# EasyEDA Pro project URADORRY-SUN1.2.eprj, board Main(1.2) (continued)
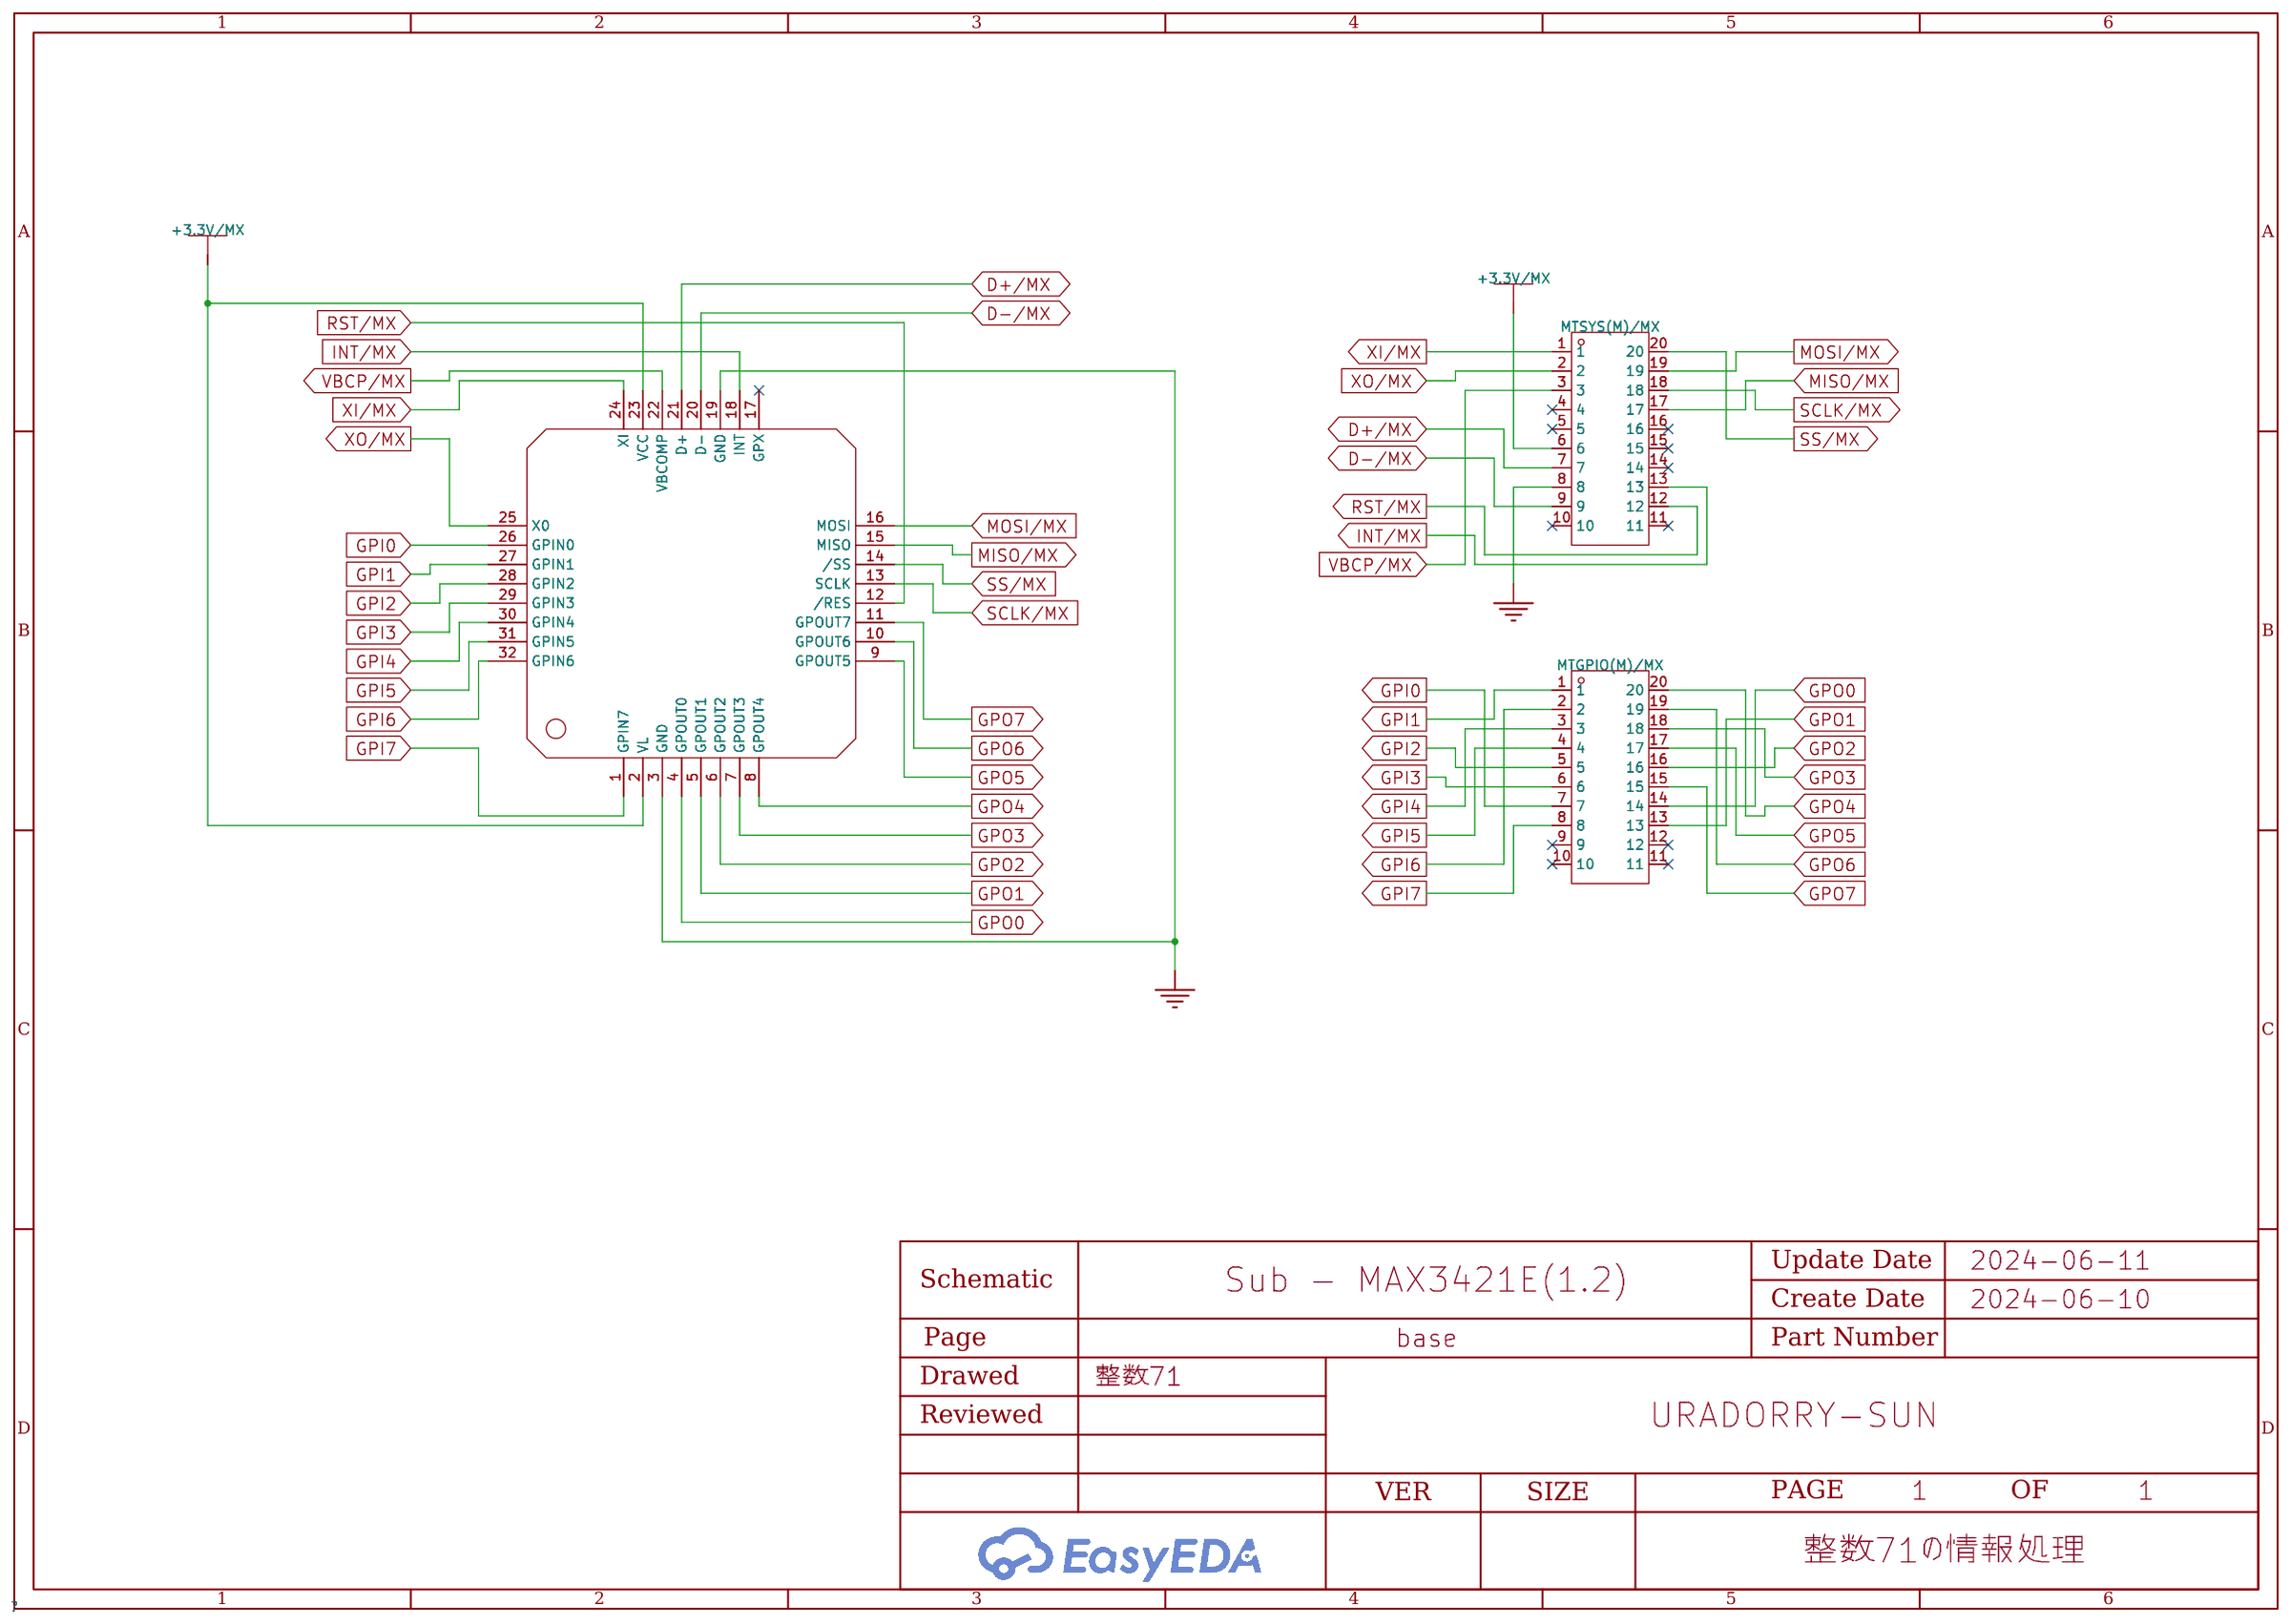
[diagram p0: schematic sheet]
## Routing (per net, layer and track width the routed paths; a pad name or vN(x,y) marks a point on that pad's centre or on a via; arc(x,y) is an arc through that point) (continued)
+3.3V/MX: length 43.3
  Top Layer w0.254: JP+3.3V.3 66.99,11.75 v1(65.09,11.75) ; RINT/MX.1 33.46,19.06 34.28,19.06 v1(34.29,19.05) ; v1(39.69,20) 39.69,21.27 40,21.59 40,21.61 40.85,21.61
  Bottom Layer w0.254: v1(65.09,11.75) 62.87,11.75 61.59,13.02 60.01,13.02 59.37,13.65 57.78,13.65 57.15,14.29 56.2,14.29 54.93,15.56 52.39,15.56 52.07,15.24 51.12,15.24 50.16,16.19 49.21,16.19 47.31,18.1 44.77,18.1 44.45,18.42 42.86,18.42 42.23,19.05 40.64,19.05 v1(39.69,20) 35.24,20 v1(34.29,19.05)
+5V/U: length 122.9
  Top Layer w0.254: v1(73.34,14.61) 73.34,13.65 73.52,13.48 Type-C.A4B9 ; Type-A.1 11.43,25.89 11.43,29.21 11.75,29.53 11.75,30.8 13.02,32.07 13.02,33.66 v1(13.97,34.61) ; v1(59.69,36.2) 58.74,37.15 v1(56.83,37.15) ; Micro-B.1 75.53,25.37 v1(75.25,25.08) ; v1(72.39,38.42) v1(70.49,38.42) ; v1(73.34,18.73) 73.8,18.28 Type-C.B4A9 ; v1(64.45,38.74) v1(62.23,38.74)
  Bottom Layer w0.254: JP+5V.3 78.11,8.26 73.98,8.26 73.03,9.21 73.03,9.84 73.34,10.16 v1(73.34,14.61) 73.34,16.83 73.99,17.47 73.99,18.1 73.35,18.73 v1(73.34,18.73) 73.34,22.23 74.61,23.5 74.61,24.45 v1(75.25,25.08) 75.25,25.72 78.11,28.58 78.11,29.53 77.79,29.85 77.79,30.48 79.38,32.07 79.38,32.7 78.42,33.66 77.79,33.66 76.84,34.61 76.84,37.78 75.88,38.74 75.25,38.74 74.93,38.42 v1(72.39,38.42) ; v1(13.97,34.61) 30.8,34.61 33.34,37.15 v1(56.83,37.15) ; v1(59.69,36.2) v1(62.23,38.74) ; v1(70.49,38.42) 70.17,38.74 v1(64.45,38.74)
AREF/AT: length 8.2
  Top Layer w0.254: v1(55.88,16.83) 55.25,16.19 CAREF/AT.2 ; v1(58.74,19.05) 59.37,19.69 59.37,20 60.08,20.71 MTSYS(F)/AT.15
  Bottom Layer w0.254: v1(58.74,19.05) 57.78,18.1 57.78,17.78 56.83,16.83 v1(55.88,16.83)
CTS-AT/AD: length 11.8
  Top Layer w0.254: UARTtoRS232C.9 22.61,27.69 22.86,27.94 23.81,27.94 24.45,27.31 24.45,20.64 JPCTS-AT.2
CTS-RS/AD: length 12.3
  Top Layer w0.254: 22.61,21.3 22.61,22.79 21.59,23.81 v1(17.78,23.81)
  Bottom Layer w0.254: JPCTS-RS.1 17.15,20.32 17.15,23.18 v1(17.78,23.81)
CTS/AT: length 54.3
  Top Layer w0.254: LEDTX/AT.1 66.21,13.65 v1(60.96,13.65) ; JPCTS-AT.1 27.31,20.32 v1(27.31,24.45) ; v1(52.71,17.78) 53.02,18.1 53.97,18.1 54.58,18.71 55.72,18.71 55.88,18.55 55.88,17.78 56.52,17.15 56.52,16.19 v1(57.15,15.56)
  Bottom Layer w0.254: v1(52.71,17.78) 52.07,17.15 51.12,17.15 50.16,18.1 49.53,18.1 46.36,21.27 45.72,21.27 44.77,22.23 43.18,22.23 39.37,26.04 29.53,26.04 28.89,25.4 28.26,25.4 v1(27.31,24.45) ; v1(57.15,15.56) 58.42,14.29 59.37,14.29 60.01,13.65 v1(60.96,13.65)
CTS/RS: length 18.9
  Bottom Layer w0.254: JPCTS-RS.2 12.07,20.32 12.07,29.53 11.75,29.85 11.75,30.8 12.7,31.75 15.88,31.75 16.19,32.07 16.19,32.07 17.26,33.14 D-SUB(9F).8
D+/AT: length 25.6
  Top Layer w0.254: v1(69.22,18.1) 66.99,20.32 66.99,21.27 65.72,22.54 65.72,22.86 65.38,23.21 MTAPP(F)/AT.1 ; v1(73.03,6.67) 73.98,5.72 75.56,5.72 JPD+.2
  Bottom Layer w0.254: v1(69.22,18.1) 69.22,11.11 70.49,9.84 70.49,9.21 71.44,8.26 72.07,8.26 73.03,7.3 v1(73.03,6.67)
D+/MX: length 18.1
  Top Layer w0.254: RD+/UH.1 27.62,15.88 31.75,20 31.75,21.91 32.39,22.54 33.02,22.54 33.45,22.11 35.4,22.11 MTSYS(F)/MX.17
D+/UD: length 17.9
  Top Layer w0.254: JPD+.3 75.56,8.26 73.98,8.26 73.03,9.21 73.03,9.84 71.44,11.43 71.44,20.84 RD+/UD.1
D-/AT: length 23.7
  Top Layer w0.254: MTAPP(F)/AT.2 63.87,22.71 63.72,22.86 63.18,22.86 62.23,21.91 62.23,21.37 62.87,20.73 62.87,20 63.5,19.37 63.5,17.78 67.94,13.34 67.94,12.38 70.49,9.84 70.49,9.21 71.44,8.26 73.03,8.26 JPD-.2
D-/MX: length 18
  Top Layer w0.254: RD-/UH.1 27.94,16.83 31.12,20 31.12,21.91 32.4,23.2 33.02,23.2 33.61,22.61 MTSYS(F)/MX.16
D-/UD: length 11
  Top Layer w0.254: RD-/UD.1 72.07,11.75 JPD-.3
GPI0: length 25.2
  Top Layer w0.254: v1(44.45,21.59) 43.93,22.11 MTGPIO(F)/MX.17 ; 27.94,10.06 v1(27.94,8.89)
  Inner1 w0.254: v1(27.94,8.89) 37.47,18.42 39.05,18.42 42.23,21.59 v1(44.45,21.59)
GPI1: length 24.4
  Top Layer w0.254: v1(44.13,17.78) 42.39,19.53 MTGPIO(F)/MX.20 ; SW-GPI/MX.15 v1(29.21,8.89)
  Inner1 w0.254: v1(44.13,17.78) 42.86,16.51 41.91,16.51 40.96,15.56 40.96,15.24 40.64,14.92 40.32,14.92 38.1,12.7 37.15,12.7 33.66,9.21 33.66,8.51 33.4,8.26 29.84,8.26 v1(29.21,8.89)
GPI2: length 23
  Top Layer w0.254: SW-GPI/MX.14 v1(30.48,8.89) ; v1(44.13,20.32) 44.13,20.98 43.5,21.61 MTGPIO(F)/MX.18
  Inner1 w0.254: v1(30.48,8.89) 32.07,10.48 32.7,10.48 36.19,13.97 38.1,13.97 38.42,14.29 38.42,15.56 43.18,20.32 v1(44.13,20.32)
GPI3: length 22.7
  Top Layer w0.254: SW-GPI/MX.13 v1(31.75,8.89) ; MTGPIO(F)/MX.3 47.01,21.61 v1(46.04,20.64)
  Inner2 w0.254: v1(31.75,8.89) 36.83,13.97 38.1,13.97 39.69,15.56 39.69,15.88 40,16.19 40.32,16.19 43.18,19.05 43.81,19.05 45.4,20.64 v1(46.04,20.64)
GPI4: length 19.3
  Top Layer w0.254: SW-GPI/MX.12 v1(33.02,8.89) ; MTGPIO(F)/MX.19 43.34,21.11 43.5,20.96 v1(43.5,19.69)
  Inner1 w0.254: v1(33.02,8.89) 33.02,9.21 37.15,13.34 38.1,13.34 39.05,14.29 39.05,15.24 v1(43.5,19.69)
GPI5: length 24.3
  Top Layer w0.254: MTGPIO(F)/MX.2 49.06,21.11 v1(49.21,20.96) ; SW-GPI/MX.11 v1(34.29,8.89)
  Inner1 w0.254: v1(34.29,8.89) 37.47,12.07 38.1,12.07 40,13.97 42.55,13.97 43.18,14.61 43.18,15.88 44.77,17.46 44.77,19.05 45.72,20 46.36,20 47.31,20.96 v1(49.21,20.96)
GPI6: length 19.7
  Top Layer w0.254: v1(46.04,19.37) 47.28,20.61 MTGPIO(F)/MX.1 ; 35.56,10.06 v1(35.56,8.89)
  Inner1 w0.254: v1(46.04,19.37) 45.4,18.73 45.4,17.46 43.81,15.88 43.81,14.61 42.55,13.34 40,13.34 v1(35.56,8.89)
GPI7: length 21.2
  Top Layer w0.254: MTGPIO(F)/MX.4 49.01,22.11 v1(49.21,21.91) ; SW-GPI/MX.9 v1(36.83,8.89)
  Inner2 w0.254: v1(49.21,21.91) 46.67,19.37 46.67,19.05 43.18,15.56 43.18,14.61 42.55,13.97 41.91,13.97 v1(36.83,8.89)
GPO0: length 41.8
  Top Layer w0.254: v1(46.67,23.5) 46.79,23.61 MTGPIO(F)/MX.7
  Inner2 w0.254: RLEDGPO0.1 12.96,13.34 16.19,13.34 16.83,12.7 18.1,12.7 18.73,12.07 26.03,12.07 28.2,14.23 32.64,14.23 36.83,18.42 39.05,18.42 41.59,20.96 44.77,20.96 45.09,21.27 45.09,21.91 v1(46.67,23.5)
GPO1: length 35.8
  Top Layer w0.254: MTGPIO(F)/MX.14 43.43,23.61 43.5,23.54 v1(43.5,23.5)
  Inner1 w0.254: v1(43.5,23.5) 41.91,23.5 40,21.59 38.74,21.59 32.7,15.56 28.89,15.56 26.03,12.7 22.54,12.7 21.91,13.34 14.86,13.34 RLEDGPO1.1
GPO2: length 37.3
  Top Layer w0.254: MTGPIO(F)/MX.8 46.34,24.11 v1(45.72,23.5)
  Inner2 w0.254: v1(45.72,23.5) 44.77,22.54 44.13,22.54 43.81,22.23 41.28,22.23 40,20.96 38.74,20.96 32.7,14.92 28.26,14.92 26.03,12.7 18.73,12.7 18.1,13.34 16.77,13.34 RLEDGPO2.1
GPO3: length 35.3
  Top Layer w0.254: MTGPIO(F)/MX.9 45.88,24.61 v1(45.72,24.45)
  Inner2 w0.254: v1(45.72,24.45) 45.09,23.81 45.09,23.43 44.83,23.18 44.13,23.18 43.81,22.86 41.28,22.86 40,21.59 38.74,21.59 32.7,15.56 28.26,15.56 26.03,13.34 18.67,13.34 RLEDGPO3.1
GPO4: length 33.4
  Top Layer w0.254: MTGPIO(F)/MX.10 45.69,25.11 v1(45.4,25.4)
  Inner2 w0.254: v1(45.4,25.4) 44.45,25.4 43.81,26.04 37.78,26.04 33.02,21.27 32.7,21.27 29.21,17.78 25.08,17.78 24.13,16.83 22.28,16.83 RLEDGPO4.1
GPO5: length 29.5
  Top Layer w0.254: MTGPIO(F)/MX.12 43.98,24.61 v1(44.13,24.77)
  Inner1 w0.254: v1(44.13,24.77) 40.96,24.77 34.61,18.42 31.12,18.42 26.03,13.34 22.48,13.34 RLEDGPO5.1
GPO6: length 25.9
  Top Layer w0.254: MTGPIO(F)/MX.11 43.21,25.11 v1(43.5,25.4)
  Inner1 w0.254: RLEDGPO6.1 24.51,15.24 26.67,15.24 32.07,20.64 32.39,20.64 33.66,21.91 37.47,21.91 40.96,25.4 v1(43.5,25.4)
GPO7: length 25.5
  Top Layer w0.254: MTGPIO(F)/MX.13 44.15,24.11 v1(44.45,23.81)
  Inner2 w0.254: RLEDGPO7.1 25.4,14.29 28.26,17.15 29.21,17.15 30.48,18.42 32.07,18.42 37.47,23.81 39.37,23.81 39.69,24.13 44.13,24.13 v1(44.45,23.81)
INT/MX: length 10
  Top Layer w0.254: v1(30.48,20.32) 30.48,21.91 32.39,23.81 33.02,23.81 33.22,23.61 MTSYS(F)/MX.14 ; RINT/MX.2 v1(31.75,19.05)
  Bottom Layer w0.254: v1(30.48,20.32) v1(31.75,19.05)
MISO/AT: length 21.3
  Top Layer w0.254: v1(60.64,8.57) 61.59,7.62 JPMISO.2 ; MTSYS(F)/AT.20 58.77,23.21 56.83,21.27 56.83,18.73 57.78,17.78 57.78,16.51 58.42,15.88 58.42,11.75 v1(59.37,10.8)
  Bottom Layer w0.254: v1(60.64,8.57) 60.33,8.89 60.33,9.84 v1(59.37,10.8)
MISO/IC: length 15.1
  Bottom Layer w0.254: JPMISO.1 60.33,3.18 56.2,3.18 53.02,6.35 50.16,6.35 PINICSP.1
MISO/MX: length 35
  Top Layer w0.254: MTSYS(F)/MX.12 36.67,24.61 37.78,23.5 37.78,19.05 v1(39.05,17.78)
  Bottom Layer w0.254: v1(39.05,17.78) 42.23,17.78 43.5,16.51 45.09,16.51 49.21,12.38 53.02,12.38 53.97,11.43 59.69,11.43 JPMISO.3
MOSI/AT: length 21.3
  Top Layer w0.254: MTSYS(F)/AT.19 58.9,22.71 57.47,21.27 57.47,18.73 58.42,17.78 58.42,16.51 59.06,15.88 v1(59.06,15.56) ; JPMOSI.2 62.87,8.26 62.87,9.84 60.33,12.38 v1(60.33,14.29)
  Bottom Layer w0.254: v1(59.06,15.56) v1(60.33,14.29)
MOSI/IC: length 19.6
  Top Layer w0.254: JPMOSI.1 62.87,3.18 61.28,3.18 60.64,2.54 v1(53.97,2.54)
  Bottom Layer w0.254: PINICSP.4 47.62,3.81 52.71,3.81 v1(53.97,2.54)
MOSI/MX: length 37.8
  Top Layer w0.254: MTSYS(F)/MX.11 36.76,25.11 38.42,23.45 38.42,19.37 v1(38.74,19.05) ; v1(61.28,12.38) JPMOSI.3
  Bottom Layer w0.254: v1(61.28,12.38) 60.01,12.38 59.37,13.02 57.78,13.02 57.15,13.65 56.2,13.65 54.93,14.92 52.39,14.92 52.07,14.61 51.12,14.61 50.16,15.56 46.67,15.56 45.09,17.15 43.5,17.15 42.23,18.42 39.37,18.42 v1(38.74,19.05)
PB4: length 26.4
  Top Layer w0.254: PINPB4.1 74.3,33.66 74.3,31.75 73.03,30.48 73.03,29.21 v1(72.39,28.58) ; v1(66.04,21.27) 65.47,20.71 MTAPP(F)/AT.6
  Bottom Layer w0.254: v1(72.39,28.58) 72.39,28.26 66.04,21.91 v1(66.04,21.27)
PB5: length 26.7
  Top Layer w0.254: v1(75.88,31.75) 77.79,33.66 78.42,33.66 79.38,34.61 79.38,36.2 PINPB5.1 ; MTAPP(F)/AT.7 63.62,20.21 v1(63.5,20.32)
  Bottom Layer w0.254: v1(75.88,31.75) 74.93,31.75 72.39,29.21 72.07,29.21 71.75,28.89 71.75,28.26 70.17,26.67 69.85,26.67 v1(63.5,20.32)
PB6: length 24.4
  Top Layer w0.254: v1(77.15,31.12) 78.42,31.12 79.38,32.07 79.38,33.66 PINPB6.1 ; MTAPP(F)/AT.8 65.43,19.71 v1(66.04,20.32)
  Bottom Layer w0.254: v1(66.04,20.32) 66.68,20.96 66.68,21.91 73.03,28.26 73.03,29.21 74.93,31.12 v1(77.15,31.12)
PC6: length 22.1
  Top Layer w0.254: v1(73.66,28.89) 73.66,30.48 PINPC6.1 ; v1(66.04,19.37) 65.88,19.21 MTAPP(F)/AT.9
  Bottom Layer w0.254: v1(66.04,19.37) 67.31,20.64 67.31,21.91 73.66,28.26 v1(73.66,28.89)
PC7: length 21.4
  Top Layer w0.254: v1(66.99,19.37) 66.33,18.71 MTAPP(F)/AT.10 ; PINPC7.1 77.79,32.07 77.15,32.07 76.2,31.12 74.93,31.12 74.3,30.48 v1(74.3,29.53)
  Bottom Layer w0.254: v1(66.99,19.37) 67.94,20.32 67.94,21.91 74.3,28.26 v1(74.3,29.53)
PD0: length 34.2
  Top Layer w0.254: v1(54.61,20.32) 54.72,20.21 55.72,20.21 ; v1(63.5,26.67) v1(67.63,26.67) ; v1(74.3,35.56) 74.3,38.74 PINPD0.1
  Bottom Layer w0.254: v1(74.3,35.56) 74.3,34.61 73.34,33.66 72.71,33.66 71.44,32.39 71.12,32.39 68.26,29.53 68.26,27.31 v1(67.63,26.67) ; v1(54.61,20.32) 54.61,20.64 60.64,26.67 v1(63.5,26.67)
PD1: length 31.6
  Top Layer w0.254: v1(53.97,19.69) 54,19.71 55.72,19.71
  Bottom Layer w0.254: PINPD1.1 75.25,37.15 74.3,37.15 73.34,36.2 72.71,36.2 71.75,35.24 71.75,34.61 70.8,33.66 70.17,33.66 68.9,32.39 66.99,32.39 65.72,31.12 64.45,31.12 53.97,20.64 v1(53.97,19.69)
PD4: length 31
  Top Layer w0.254: v1(62.23,18.1) 62.23,19.05 62.1,19.18 61.14,19.18 MTSYS(F)/AT.12 ; v1(62.87,25.4) 62.87,29.53 63.5,30.16 v1(63.5,31.12)
  Bottom Layer w0.254: v1(62.87,25.4) 62.23,24.77 62.23,21.91 60.96,20.64 60.96,20 62.23,18.73 v1(62.23,18.1) ; PINPD4.1 69.85,36.83 69.85,35.88 69.53,35.56 67.63,35.56 65.72,33.66 65.09,33.66 64.14,32.7 64.14,31.75 v1(63.5,31.12)
PD6: length 29.1
  Top Layer w0.254: v1(70.49,36.51) 69.53,36.51 v1(69.22,36.2) ; v1(60.01,19.69) 61.1,19.69 MTSYS(F)/AT.13 ; v1(61.28,28.89) 61.59,28.58 v1(61.59,25.4) ; v1(62.55,33.66) 61.59,32.7 v1(61.59,32.07) ; PINPD6.1 v1(71.75,36.2)
  Bottom Layer w0.254: v1(61.28,28.89) 61.28,30.16 61.59,30.48 v1(61.59,32.07) ; v1(60.01,19.69) 60.01,23.81 v1(61.59,25.4) ; v1(69.22,36.2) 65.09,36.2 64.14,35.24 64.14,34.61 63.18,33.66 v1(62.55,33.66) ; v1(71.75,36.2) 71.44,36.51 v1(70.49,36.51)
PD7: length 18.3
  Top Layer w0.254: v1(62.23,20.32) 62.12,20.21 MTSYS(F)/AT.14
  Bottom Layer w0.254: PINPD7.1 70.49,29.85 70.49,27.58 70.21,27.31 69.85,27.31 66.68,24.13 66.36,24.13 63.18,20.96 62.87,20.96 v1(62.23,20.32)
PE6: length 15.2
  Top Layer w0.254: v1(68.58,33.02) 68.58,31.43 68.26,31.12 68.26,27.62 68.9,26.99 68.9,26.67 71.44,24.13 71.44,23.5 71.15,23.21 70.01,23.21
  Bottom Layer w0.254: v1(68.58,33.02) PINPE6.1
PF0: length 23.2
  Top Layer w0.254: v1(71.44,31.75) 71.75,32.07 71.75,35.24 71.12,35.88 71.12,36.83 PINPF0.1 ; v1(68.9,27.94) 69.53,27.31 69.53,26.67 72.07,24.13 72.07,23.5 70.78,22.21 70.01,22.21
  Bottom Layer w0.254: v1(68.9,27.94) 68.9,29.21 v1(71.44,31.75)
PF1: length 17.9
  Top Layer w0.254: MTAPP(F)/AT.17 69.1,21.71 68.26,22.54 68.26,24.77 v1(66.99,26.04) ; v1(67.94,31.75) PINPF1.1
  Bottom Layer w0.254: v1(67.94,31.75) 67.63,31.43 67.63,27.62 66.99,26.99 v1(66.99,26.04)
PF4: length 22.8
  Top Layer w0.254: PINPF4.1 66.68,38.74 66.68,31.43 v1(66.99,31.12) ; v1(66.36,25.4) 67.63,24.13 67.63,22.54 68.9,21.27 68.9,20.32 69.01,20.21 70.01,20.21
  Bottom Layer w0.254: v1(66.99,31.12) 66.36,30.48 v1(66.36,25.4)
PF5: length 21.4
  Top Layer w0.254: MTAPP(F)/AT.13 68.88,19.71 68.26,20.32 68.26,21.27 66.99,22.54 66.99,23.81 65.72,25.08 v1(65.72,26.04) ; v1(64.14,36.2) 64.14,31.43 v1(65.09,30.48)
  Bottom Layer w0.254: v1(65.72,26.04) 65.72,29.85 v1(65.09,30.48) ; v1(64.14,36.2) PINPF5.1
PF6: length 30.4
  Top Layer w0.254: 70.01,19.21 68.74,19.21 67.63,20.32 67.63,21.27 66.36,22.54 66.36,22.9 65.45,23.81 62.23,23.81 59.06,26.99 59.06,33.34 v1(59.69,33.97) ; PINPF6.1 64.77,35.56 64.77,36.51 64.45,36.83 63.82,36.83 63.18,36.2 62.55,36.2 v1(60.96,34.61)
  Bottom Layer w0.254: v1(60.96,34.61) 60.33,34.61 v1(59.69,33.97)
PF7: length 17.1
  Top Layer w0.254: PINPF7.1 65.41,31.75 v1(66.99,30.16) ; v1(70.8,23.81) 68.26,26.35 68.26,26.99 v1(66.99,28.26) ; v1(70.8,18.42) 70.51,18.71 70.01,18.71
  Bottom Layer w0.254: v1(66.99,30.16) v1(66.99,28.26) ; v1(70.8,18.42) v1(70.8,23.81)
RAW: length 62.9
  Top Layer w0.254: SPLY+7V.3 SPLY+7V.4 42.73,30.28 42.61,30.16 CIN/LM.1 45.81,29.53 46.99,29.53 v1(49.21,31.75) ; v1(59.69,35.24) 59.69,34.93 58.1,33.34 58.1,31.43 JPRAW.2 57.78,25.4 v1(59.37,23.81) ; v1(66.99,10.8) 67.94,9.84 67.94,9.21 68.9,8.26 70.49,8.26 JPRAW2.2 ; v1(54.61,36.2) 55.88,36.2 ; DVBUS.1 55.88,36.19 SPLY+3.3V.3 56.13,35.94 CRAW.1 58.99,35.94 59.69,35.24
  Bottom Layer w0.254: v1(66.99,10.8) 65.09,12.7 65.09,13.02 60.01,18.1 60.01,18.73 59.37,19.37 v1(59.37,23.81) ; v1(49.21,31.75) 53.66,36.2 v1(54.61,36.2) ; v1(59.69,35.24) 62.55,35.24 PINRAW.1
RAW/IC: length 24.7
  Bottom Layer w0.254: PINICSP.2 49.53,4.45 53.02,4.45 54.93,2.54 60.64,2.54 61.28,3.18 70.49,3.18 JPRAW2.1
RST: length 87.2
  Top Layer w0.254: 55.72,23.21 54.48,24.45 v1(53.97,24.45) 53.97,25.2 RRST.2 ; SWRST.2 7.01,7.94 v1(8.57,7.94) ; v1(49.85,11.75) 48.26,13.34 48.26,13.97 48.9,14.61 48.9,18.42 50.8,20.32 50.8,22.23 50.16,22.86 50.16,24.13 v1(50.8,24.77)
  Bottom Layer w0.254: v1(8.57,7.94) 42.55,7.94 44.13,9.53 51.44,9.53 ; v1(50.8,24.77) 53.66,24.77 v1(53.97,24.45) ; 51.44,9.53 50.8,10.16 50.8,10.8 v1(49.85,11.75) ; 51.44,9.53 52.39,8.57 53.34,8.57 56.2,5.72 65.41,5.72 JPRST.2
RST/IC: length 25.2
  Top Layer w0.254: JPRST.1 65.41,5.72 56.2,5.72 54.93,6.99 v1(51.75,6.99)
  Bottom Layer w0.254: PINICSP.5 45.09,8.89 49.85,8.89 v1(51.75,6.99)
RST/MX: length 39.7
  Top Layer w0.254: 40.85,23.11 39.62,23.11 39.05,22.54 39.05,19.69 40.96,17.78 40.96,14.92 46.04,9.84 v1(54.61,9.84) ; v1(65.41,8.26) JPRST.3
  Bottom Layer w0.254: v1(65.41,8.26) 61.28,8.26 60.96,7.94 60.33,7.94 60.01,8.26 56.2,8.26 v1(54.61,9.84)
RTS-AT/AD: length 7.5
  Top Layer w0.254: UARTtoRS232C.10 21.96,25.35 22.86,24.45 23.5,24.45 v1(23.81,24.13)
  Bottom Layer w0.254: v1(23.81,24.13) 23.81,23.81 JPRTS-AT.2
RTS-RS/AD: length 8.4
  Top Layer w0.254: JPRTS-RS.1 17.46,23.18 21.59,23.18 21.96,22.81 21.96,21.3
RTS/AT: length 36.4
  Top Layer w0.254: v1(58.74,20) 59.94,21.21 MTSYS(F)/AT.16
  Bottom Layer w0.254: 29.21,21.59 30.8,21.59 31.12,21.27 40,21.27 40.32,20.96 44.45,20.96 45.4,20 46.36,20 46.99,19.37 47.31,19.37 49.21,17.46 50.16,17.46 51.12,16.51 52.07,16.51 52.39,16.83 54.29,16.83 54.93,17.46 56.83,17.46 57.15,17.78 57.15,18.42 v1(58.74,20) 58.7,20
RTS/RS: length 12.2
  Top Layer w0.254: v1(14.61,27.94) 14.61,22.86 JPRTS-RS.2 ; 14.49,33.17 14.61,33.06 v1(14.61,31.12)
  Bottom Layer w0.254: v1(14.61,27.94) v1(14.61,31.12)
RXD-AT/AD: length 7.2
  Top Layer w0.254: UARTtoRS232C.12 20.66,26.01 v1(20.96,25.72)
  Bottom Layer w0.254: JPRXD-AT.2 24.45,25.72 v1(20.96,25.72)
RXD-RS/AD: length 5.9
  Top Layer w0.254: JPRXD-RS.1 16.83,25.08 19.05,25.08 20.01,26.04 UARTtoRS232C.13
RXD/AT: length 41.1
  Top Layer w0.254: MTSYS(F)/AT.11 59.66,18.71 v1(59.37,18.42)
  Bottom Layer w0.254: v1(59.37,18.42) 57.15,16.19 52.39,16.19 52.07,15.88 51.12,15.88 50.16,16.83 49.21,16.83 47.31,18.73 44.77,18.73 44.45,19.05 42.86,19.05 42.23,19.69 40.96,19.69 40,20.64 31.12,20.64 30.8,20.96 29.53,20.96 28.89,20.32 28.26,20.32 27.31,21.27 27.31,22.86 JPRXD-AT.1
RXD/RS: length 7.2
  Top Layer w0.254: JPRXD-RS.2 12.07,25.4 12.07,29.29 D-SUB(9F).2
SCLK/AT: length 19.1
  Top Layer w0.254: MTSYS(F)/AT.18 59.03,22.21 58.1,21.27 58.1,18.73 59.06,17.78 59.06,16.51 59.69,15.88 59.69,11.43 60.01,11.11 60.01,10.16 60.33,9.84 60.33,9.21 59.69,8.57 59.69,7.62 JPSCLK.2
SCLK/IC: length 15.1
  Top Layer w0.254: v1(55.25,3.18) 57.78,3.18 JPSCLK.1
  Bottom Layer w0.254: v1(55.25,3.18) 52.71,5.72 49.85,5.72 49.21,6.35 47.62,6.35 PINICSP.3
SCLK/MX: length 34
  Top Layer w0.254: v1(37.15,22.54) 37.15,18.73 v1(40.32,15.56) ; MTSYS(F)/MX.9 39.22,24.61 v1(39.05,24.45) ; v1(43.81,13.02) 47.62,13.02 49.53,11.11 56.52,11.11 57.47,10.16 58.42,10.16 JPSCLK.3
  Bottom Layer w0.254: v1(39.05,24.45) v1(37.15,22.54) ; v1(43.81,13.02) 42.86,13.02 v1(40.32,15.56)
SS/AT: length 32.3
  Top Layer w0.254: v1(57.78,10.8) 57.78,15.88 57.15,16.51 57.15,17.46 v1(56.52,18.1) ; JPSS.2 57.78,8.26 v1(57.78,9.21) ; MTSYS(F)/AT.17 59.49,21.71 v1(58.74,20.96) ; LEDRX/AT.1 66.99,29.21 v1(65.09,27.31)
  Bottom Layer w0.254: v1(65.09,27.31) 63.82,26.04 60.64,26.04 58.74,24.13 v1(58.74,20.96) 56.52,18.73 v1(56.52,18.1) ; v1(57.78,10.8) v1(57.78,9.21)
SS/MX: length 28.3
  Top Layer w0.254: v1(45.09,15.56) 45.09,24.77 43.81,26.04 41.73,26.04 MTSYS(F)/MX.10 ; v1(50.16,10.48) 55.56,10.48 JPSS.3
  Bottom Layer w0.254: v1(45.09,15.56) v1(50.16,10.48)
TXD-AT/AD: length 6.7
  Top Layer w0.254: UARTtoRS232C.11 21.31,27.98 21.91,28.58 24.13,28.58 JPTXD-AT.2
TXD-RS/AD: length 5
  Top Layer w0.254: JPTXD-RS.1 16.83,25.72 19.05,25.72 19.36,26.03 19.36,27.03
TXD/AT: length 30.6
  Top Layer w0.254: v1(53.02,18.73) 53.97,18.73 54.45,19.21 55.72,19.21
  Bottom Layer w0.254: v1(53.02,18.73) 51.75,20 48.26,20 46.36,21.91 45.72,21.91 44.77,22.86 43.18,22.86 39.37,26.67 JPTXD-AT.1
TXD/RS: length 4.7
  Top Layer w0.254: D-SUB(9F).3 13.97,28.43 13.97,27.31 JPTXD-RS.2
UCAP/AT: length 11
  Top Layer w0.254: v1(63.5,22.23) 63.52,22.21 MTAPP(F)/AT.3 ; v1(69.85,27.94) 69.85,28.19 CUCAP/AT.2
  Bottom Layer w0.254: v1(69.85,27.94) 66.68,24.77 66.04,24.77 v1(63.5,22.23)
VBCP/MX: length 1.9
  Top Layer w0.254: MTSYS(F)/MX.19 33.71,21.11 33.59,21
XI/MX: length 12.7
  Top Layer w0.254: XTAL/MX.1 37.47,15.24 ; XTAL/MX.1 33.76,11.75 32.39,11.75 ; XTAL/MX.1 35.88,16.61 35.88,20.13 MTSYS(F)/MX.20
XO/MX: length 12.2
  Top Layer w0.254: MTSYS(F)/MX.1 42.13,19.28 XTAL/MX.2
  Bottom Layer w0.254: XTAL/MX.2 43.72,13.65 45.09,13.65 CXO/MX.2
XTAL1/AT: length 11.1
  Top Layer w0.254: 55.72,21.21 54.12,21.21 XTAL/AT.1 51.44,15.56 CXTAL1/AT.2
XTAL2/AT: length 10.6
  Top Layer w0.254: CXTAL2/AT.2 51.44,26.35 XTAL/AT.2 51.85,23.4 53.53,21.72 55.71,21.72
$1N2038: length 2.2
  Top Layer w0.254: DVBUS.2 56.43,39.92 FUSE+5V.2
$1N9461: length 2.1
  Top Layer w0.254: SPLY+7V.5 43.34,31.5 44.92,31.5 CS/LM.2
$1N9492: length 1.5
  Top Layer w0.254: SPLY+7V.1 41.23,30.18 L/LM.2
$1N10592: length 14
  Top Layer w0.254: RF1/LM.3 35.24,37.07 ; 35.24,37.07 35.24,39.21 34.45,40.01 ; 35.24,37.07 39.77,37.07 40.96,35.88 41.59,35.88 42.23,35.24 SPLY+7V.8
$1N11122: length 1.4
  Top Layer w0.254: CC1/LM.1 33.02,38.19 34.26,38.19 RC/LM.2
$1N11605: length 4.2
  Top Layer w0.254: RC/LM.1 41.68,37.93 CC2/LM.1 42.73,35.47 42.73,34.43 SPLY+7V.7
$1N32088: length 3.8
  Top Layer w0.254: LED+3.3V.1 50.74,31.12 RLED+3.3V.2
$4N1571: length 2.6
  Top Layer w0.254: 18.06,21.3 18.06,18.91 C1/AD.2
$4N1575: length 2.6
  Top Layer w0.254: C1/AD.1 19.37,18.84 19.37,21.29 19.36,21.3
$4N1757: length 4.9
  Top Layer w0.254: C2/AD.2 22.68,19.37 20.96,19.37 20.01,20.31 20.01,21.3
$4N3311: length 5.3
  Top Layer w0.254: 20.66,21.3 20.68,21.28 20.68,20.28 20.96,20 23.14,20 C2/AD.1
$4N3319: length 4.6
  Top Layer w0.254: 21.31,21.3 21.31,22.5 v1(21.27,22.54) ; v1(22.54,23.81) 23.14,23.81 C4/AD.2
  Bottom Layer w0.254: v1(22.54,23.81) v1(21.27,22.54)
$4N3330: length 7.2
  Top Layer w0.254: 18.71,21.3 18.71,22.2 v1(19.05,22.54) ; v1(20,18.1) 20.67,18.77 C3/AD.2
  Bottom Layer w0.254: v1(20,18.1) 19.37,18.73 19.37,22.23 v1(19.05,22.54)
$7N5508: length 15.5
  Top Layer w0.254: 72.19,20.44 72.71,19.92 72.71,16.83 73.41,16.13 ; 72.19,20.44 RD-/UD.2 ; 72.19,20.44 72.71,20.96 72.71,22.23 73.34,22.86 73.34,24.13 75.23,26.02 Micro-B.2 ; 73.41,16.13 73.41,15.49 73.78,15.13 Type-C.B7 ; 73.41,16.13 Type-C.A7
$7N5524: length 18.2
  Top Layer w0.254: Type-C.A6 75.31,15.63 75.56,15.88 75.56,16.45 75.39,16.63 Type-C.B6 73.55,16.63 73.34,16.83 v1(73.34,17.78) ; RD+/UD.2 72.71,22.98 v1(72.71,24.13) 75.25,26.67 Micro-B.3
  Bottom Layer w0.254: v1(73.34,17.78) 72.71,18.42 v1(72.71,24.13)
$7N5672: length 8.4
  Top Layer w0.254: RCC1/UD1.2 77.15,20.52 77.15,18.42 76.2,17.46 76.2,15.88 75.56,15.24 75.56,14.92 75.29,14.65 74.5,14.65 Type-C.A5
$7N5725: length 5.1
  Top Layer w0.254: RCC2/UD1.2 76.52,18.42 75.73,17.63 Type-C.B5
$7N8485: length 1.5
  Top Layer w0.254: LEDRX/AT.2 RLEDRX/AT.2
$7N8666: length 1.5
  Top Layer w0.254: LEDTX/AT.2 65.55,12.7 RLEDTX/AT.2
$8N2718: length 13.3
  Top Layer w0.254: Type-A.2 11.11,20.89 11.11,19.69 13.97,16.83 RD-/UH.2
$8N2723: length 12.2
  Top Layer w0.254: RD+/UH.2 14.13,15.88 Type-A.3
$8N3290: length 1.5
  Top Layer w0.254: RLEDGPO0.2 LEDGPO0.2
$8N3292: length 1.4
  Top Layer w0.254: RLEDGPO1.2 LEDGPO1.1
$8N4284: length 1.5
  Top Layer w0.254: RLEDGPO4.2 19.68,6.72 LEDGPO4.2
$8N4287: length 1.5
  Top Layer w0.254: RLEDGPO5.2 21.59,5.25 LEDGPO5.2
$8N4290: length 1.5
  Top Layer w0.254: RLEDGPO6.2 LEDGPO6.2
$8N4293: length 1.5
  Top Layer w0.254: RLEDGPO7.2 LEDGPO7.2
$8N55909: length 1.5
  Top Layer w0.254: LEDGPO2.2 15.88,5.25 RLEDGPO2.2
$8N63158: length 1.5
  Top Layer w0.254: LEDGPO3.2 17.78,5.25 17.78,6.72 RLEDGPO3.2

## Text on the board
Top Silkscreen Layer: USB / +UHS | <SPI | <GPO | <USB | USB> | GPI> | UART> | PXn> | SS | SCLK | MISO | MOSI | RST | VCC | RAW | D- | D+ | VBUS | RESET | SERIAL | TXD | RXD | RTS | CTS | +7V | MAX3421E | +3.3V | JP-MODE | GND | +5V | ATmega32U4 | PF6 | PF7 | PE6 | PF0 | PF1 | PD4 | PD6 | PD7 | PC6 | PC7 | PD0 | PD1 | PB4 | PB5 | ICSP | 1 | 2 | AD<->RS | 3 | 4 | 5 | 6 | 7 | 8 | AT<->AD | PB6 | URADORRY-SUN / Rev1.1
